# EasyEDA Pro project 小键盘示例板.eprj, schematic 1x3+6
Create Date: 2022-11-08; Page Name: 1x3+6; Project Name: CV键盘三键键盘四键键盘九键键盘有线小键盘; Schematic Name: 1x3+6; Update Date: 2023-03-08; Company: 嘉立创EDA; Page Size: A4; Version: V1.0
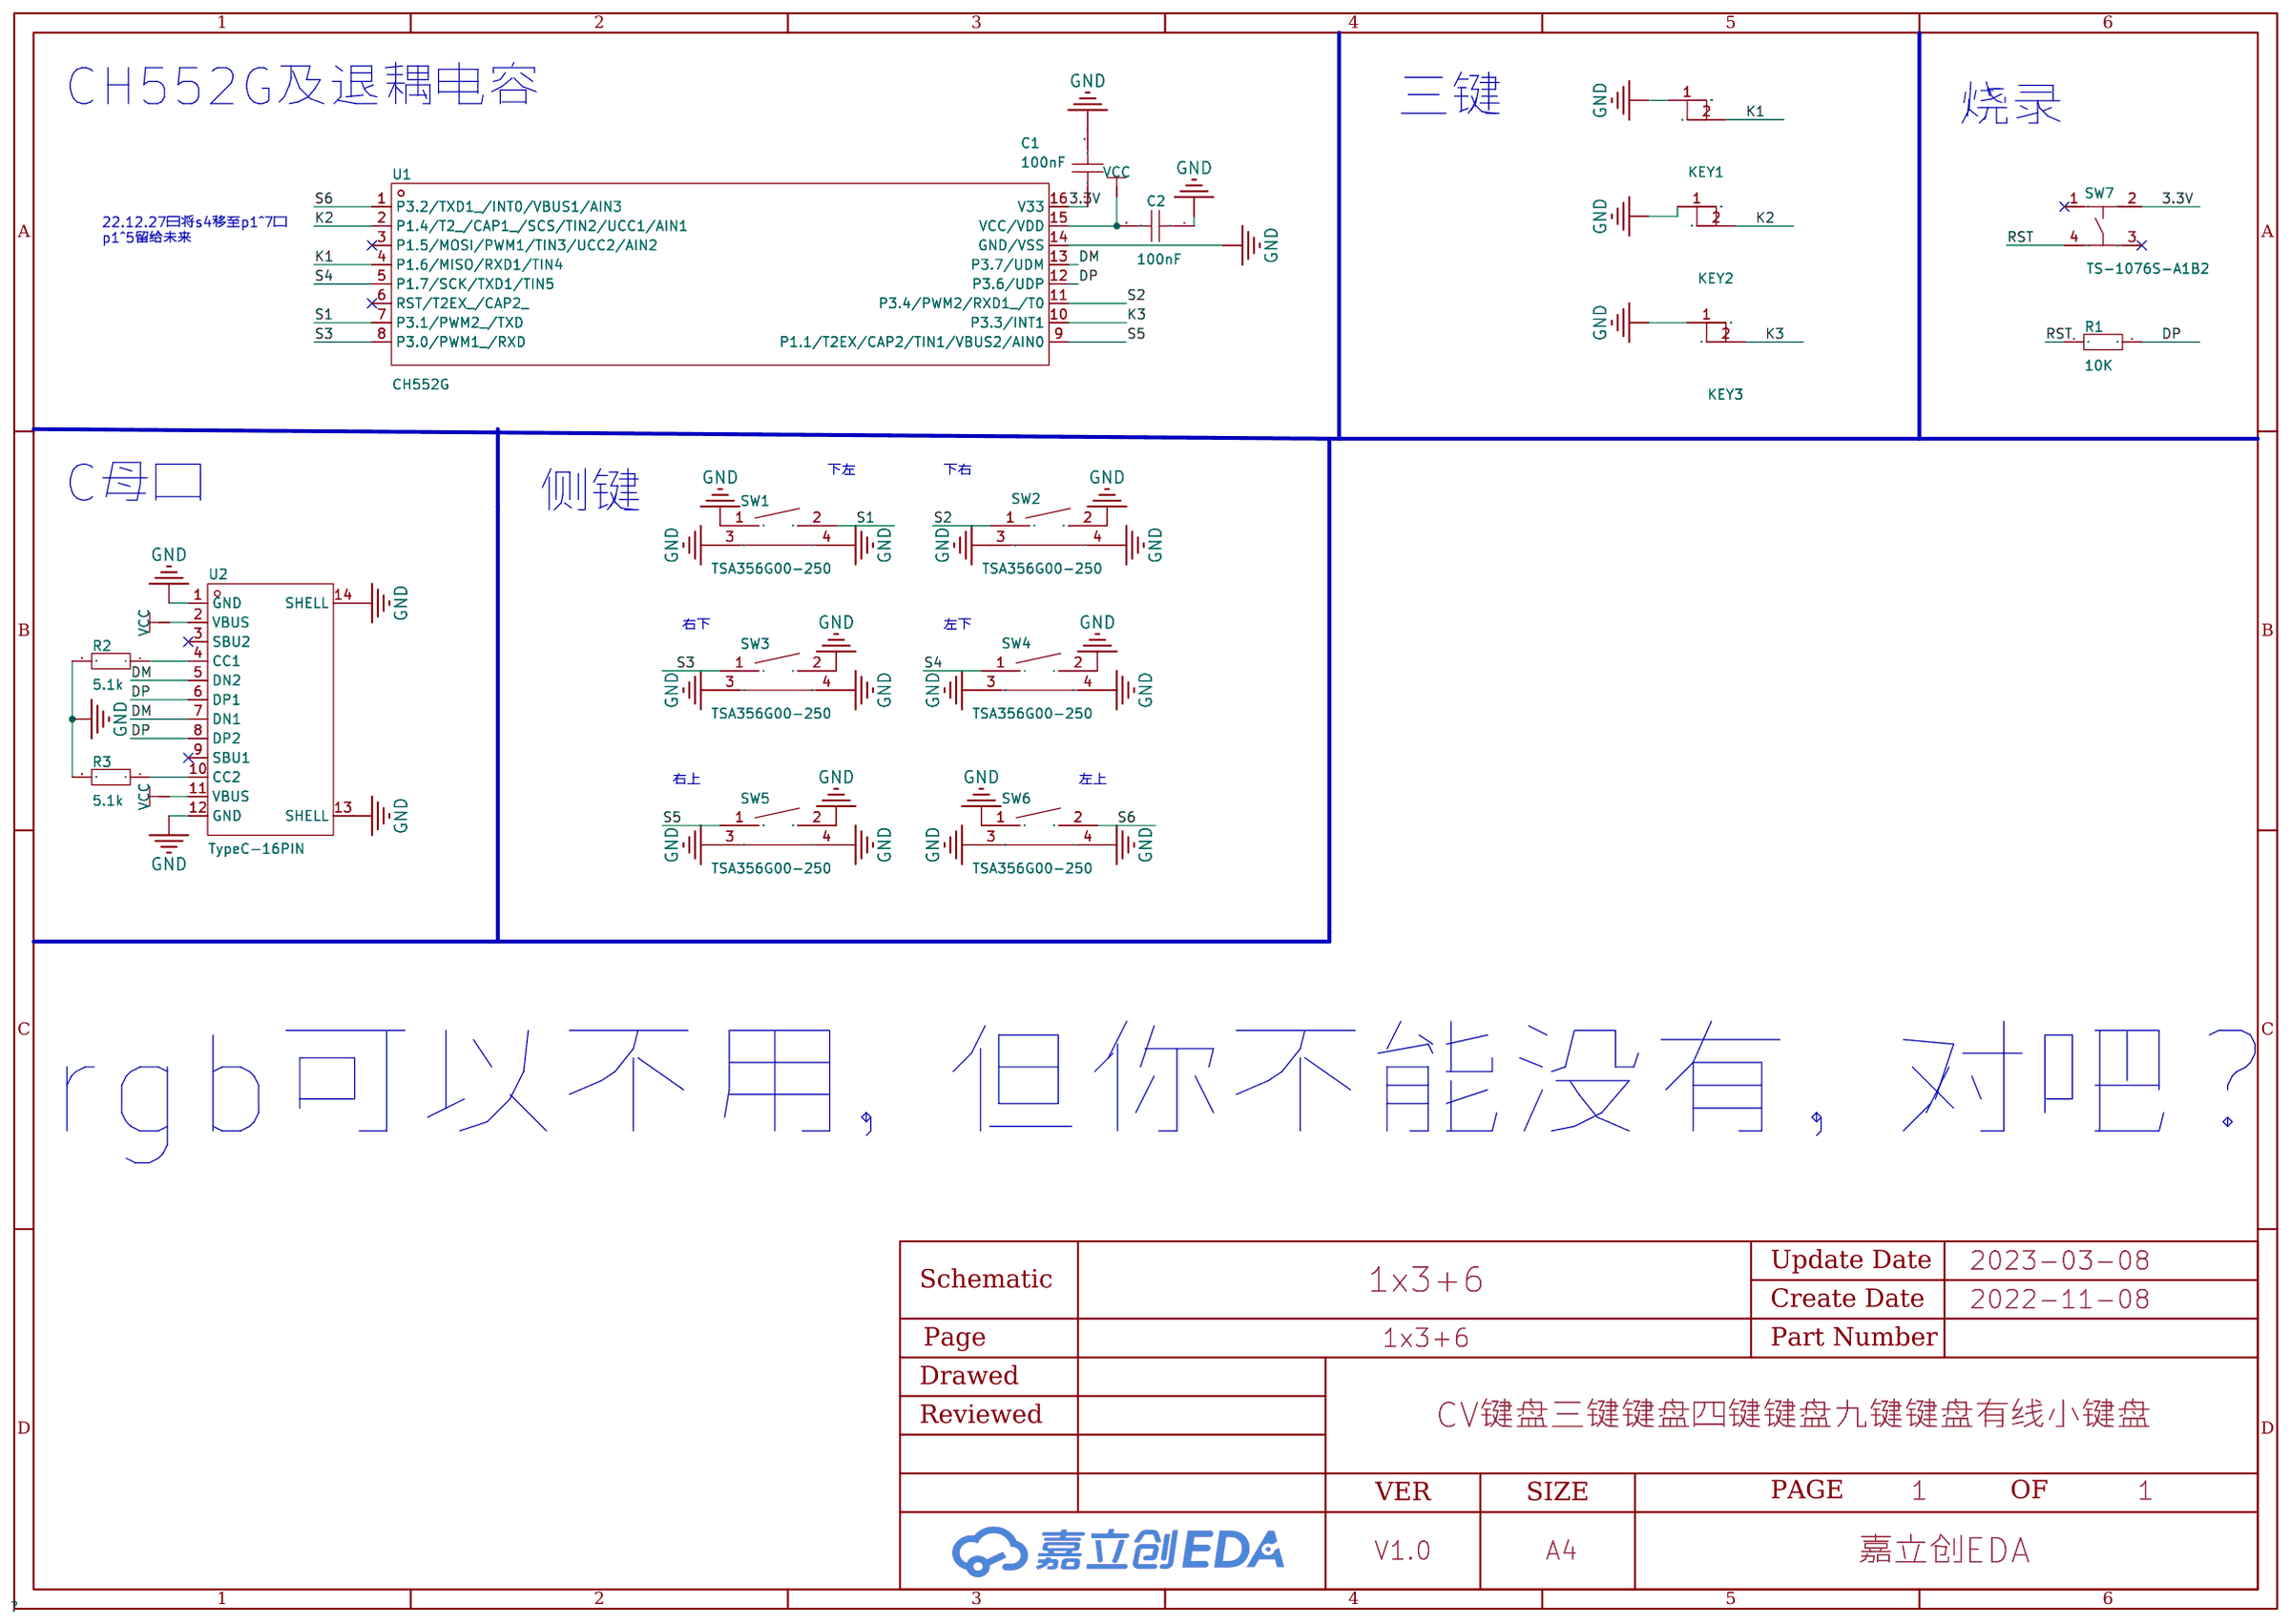
[diagram p0: schematic sheet]

## Parts
C1  100nF  [C0603]
C2  100nF  [C0603]
KEY1  -  [热插拔轴座]
KEY2  -  [热插拔轴座]
KEY3  -  [热插拔轴座]
R1  10K  [R0603]
R2  5.1k  [R0603]
R3  5.1k  [R0603]
SW1  TSA356G00-250  [SW-SMD_TSA356G00-250]
SW2  TSA356G00-250  [SW-SMD_TSA356G00-250]
SW3  TSA356G00-250  [SW-SMD_TSA356G00-250]
SW4  TSA356G00-250  [SW-SMD_TSA356G00-250]
SW5  TSA356G00-250  [SW-SMD_TSA356G00-250]
SW6  TSA356G00-250  [SW-SMD_TSA356G00-250]
SW7  TS-1076S-A1B2  [SW-SMD_4P-L5.2-W5.2-P3.70-LS6.4]
U1  CH552G  [SOP-16_L10.0-W3.9-P1.27-LS6.0-BL]
U2  TypeC-16PIN  [USB-C-SMD_TYPE-C-6PIN-2MD-073]

## Library data of the parts
C1 C2 = CAP_0603: Supplier Footprint: 0603
KEY1-KEY3 = 热插拔轴座
R1-R3 = Res_0603: Supplier Footprint: 0603
SW1-SW6 = TSA356G00-250: 触点电流:50mA;额定电压(DC):12V;绝缘电阻:100MΩ;电路结构:单刀单掷;安装方式:立贴;按钮形状:方形按钮;按钮/盖帽颜色:白色;带灯:无;作用力:250gf@±50gf;机械寿命:50000;工作温度:-25~+70;引脚样式:J型引脚;开关长度:6.1mm;开关宽度:3.5mm;开关高度:3.05mm;带支架:否;; LCSC Part Name: 3*5 沉板 250gf; Supplier Part: C354961; Manufacturer: BRIGHT(博瑞泰); Supplier Footprint: SMD; JLCPCB Part Class: 扩展库; Datasheet: https://atta.szlcsc.com/upload/public/pdf/source/20190426/C354961_BA62AE61DB5B31DA07A03838F7361CD1.pdf; Supplier: LCSC; Contact Current: 50mA; Voltage Rating (DC): 12V; Insulation Resistance: 100MΩ; Circuit: 单刀单掷; Mounting Style: 立贴; Actuator Style: 方形按钮; Actuator/Cap Color: 白色; With Lamp: 无; Operating Force: 250gf@±50gf; Mechanical Life: 50000; Operating Temperature: -25~+70; Pin Style: J型引脚; Switch Length: 6.1mm; Switch Width: 3.5mm; Switch Height: 3.05mm; Strike Gundam: 否
SW7 = TS-1076S-A1B2: 电路结构:单刀单掷;安装方式:立贴;按钮形状:圆形按钮;按钮/盖帽颜色:黄色;作用力:180gf@±30gf;引脚样式:鸥翼型;开关长度:5.2mm;开关宽度:5.2mm;开关高度:1.5mm;带支架:否;; LCSC Part Name: 轻触开关5.2*5.2*1.5mm铜头4*4*1.5贴片四脚按键180gf; Supplier Part: C730314; Manufacturer: Yuandi(台湾元迪); Supplier Footprint: SMD; JLCPCB Part Class: 扩展库; Datasheet: https://atta.szlcsc.com/upload/public/pdf/source/20200824/C730314_E50465657130F0F00B9B8F6AA0750946.pdf; Supplier: LCSC; Circuit: 单刀单掷; Mounting Style: 立贴; Actuator Style: 圆形按钮; Actuator/Cap Color: 黄色; Operating Force: 180gf@±30gf; Pin Style: 鸥翼型; Switch Length: 5.2mm; Switch Width: 5.2mm; Switch Height: 1.5mm; Strike Gundam: 否
U1 = CH552G: CPU内核:51系列;CPU最大主频:24MHz;工作电压范围:3.3V~5V;内部振荡器:有;外部时钟频率范围:6MHz~25MHz;程序 FLASH容量:16KB;RAM总容量:1.25KB;EEPROM/数据 FLASH容量:128Byte;GPIO端口数量:-;ADC(单元数/通道数/位数):1@x4ch/8bit;DAC(单元数/通道数/位数):-;(E)PWM(单元数/通道数/位数):2@x8bit;8位Timer数量:-;16位Timer数量:3;32位Timer数量:-;内部比较器数量:-; LCSC Part Name: 51系列 24MHz 闪存：16KB RAM：1.25KB; Supplier Part: C111292; Manufacturer: WCH(南京沁恒); Supplier Footprint: SOP-16_150mil; JLCPCB Part Class: 扩展库; Datasheet: https://atta.szlcsc.com/upload/public/pdf/source/20200819/C111292_2988E0DDEDF937C7B5A075A68BF2AC9C.pdf; Supplier: LCSC; CPU Core: 51系列; Maximum Frequency: 24MHz; Supply Voltage Range: 3.3V~5V; Internal Oscillator: 有; External Clock Frequency Rang: 6MHz~25MHz; Program FLASH Size: 16KB; RAM Size: 1.25KB; EEPROM/Data FLASH Size: 128Byte; ADC (Units/Channels/bits): 1@x4ch/8bit; (E)PWM (Units/Channels/bits): 2@x8bit; 16Bit Timer Number: 3; U(S)ART Number: 2; (Q)SPI Number: 1; USB (H/D/OTG): 全速USB Device; Peripherals / Functions / Protocol Stacks: DMA；看门狗；CCP捕获/比较；触控按键; Operating Temperature Range: -40~+85
U2 = TypeC-16PIN: Supplier Part: C9900016187; JLCPCB Part Class: 扩展库; Datasheet: https://atta.szlcsc.comnull; Supplier: LCSC

## Nets
3.3V: C1.1 SW7.2 U1.16(V33)
GND: C1.2 C2.1 KEY1.1(Pin1) KEY2.1(Pin1) KEY3.1(Pin1) R2.2 R3.2 SW1.1 SW1.3 SW1.4 SW2.2 SW2.3 SW2.4 SW3.2 SW3.3 SW3.4 SW4.2 SW4.3 SW4.4 SW5.2 SW5.3 SW5.4 SW6.1 SW6.3 SW6.4 U1.14(GND/VSS) U2.1(GND) U2.12(GND) U2.13(SHELL) U2.14(SHELL)
VCC: C2.2 U1.15(VCC/VDD) U2.2(VBUS) U2.11(VBUS)
DM: U1.13(P3.7/UDM) U2.5(DN2) U2.7(DN1)
DP: R1.1 U1.12(P3.6/UDP) U2.6(DP1) U2.8(DP2)
K1: KEY1.2(Pin2) U1.4(P1.6/MISO/RXD1/TIN4)
K2: KEY2.2(Pin2) U1.2(P1.4/T2_/CAP1_/SCS/TIN2/UCC1/AIN1)
K3: KEY3.2(Pin2) U1.10(P3.3/INT1)
RST: R1.2 SW7.4
S1: SW1.2 U1.7(P3.1/PWM2_/TXD)
S2: SW2.1 U1.11(P3.4/PWM2/RXD1_/T0)
S3: SW3.1 U1.8(P3.0/PWM1_/RXD)
S4: SW4.1 U1.5(P1.7/SCK/TXD1/TIN5)
S5: SW5.1 U1.9(P1.1/T2EX/CAP2/TIN1/VBUS2/AIN0)
S6: SW6.2 U1.1(P3.2/TXD1_/INT0/VBUS1/AIN3)
$1N8751: R2.1 U2.4(CC1)
$1N8754: R3.1 U2.10(CC2)

Not connected (* = marked no-connect by the designer): SW7 1* 3*; U1 3(P1.5/MOSI/PWM1/TIN3/UCC2/AIN2)* 6(RST/T2EX_/CAP2_)*; U2 3(SBU2)* 9(SBU1)*

## Notes on the sheet
- CH552G及退耦电容
- 三键
- 烧录
- 22.12.27日将s4移至p1^7口
  p1^5留给未来
- 下左
- 下右
- C母口
- 侧键
- 右下
- 左下
- 右上
- 左上
- rgb可以不用，但你不能没有，对吧？
